# EasyEDA Pro project BCI_TESTING_BOARD.eprj, schematic BCI_ADS1299

## Sheets
1 ESP and Power: Board Name: CK-C3-Mini-085-4LY; Create Date: 2025-02-17; Page Name: ESP and Power; Project Name: BCI_TESTING_BOARD; Schematic Name: BCI_ADS1299; Update Date: 2025-05-24; Company: Designed by --nikki--; Page Size: A4; Version: V3.0
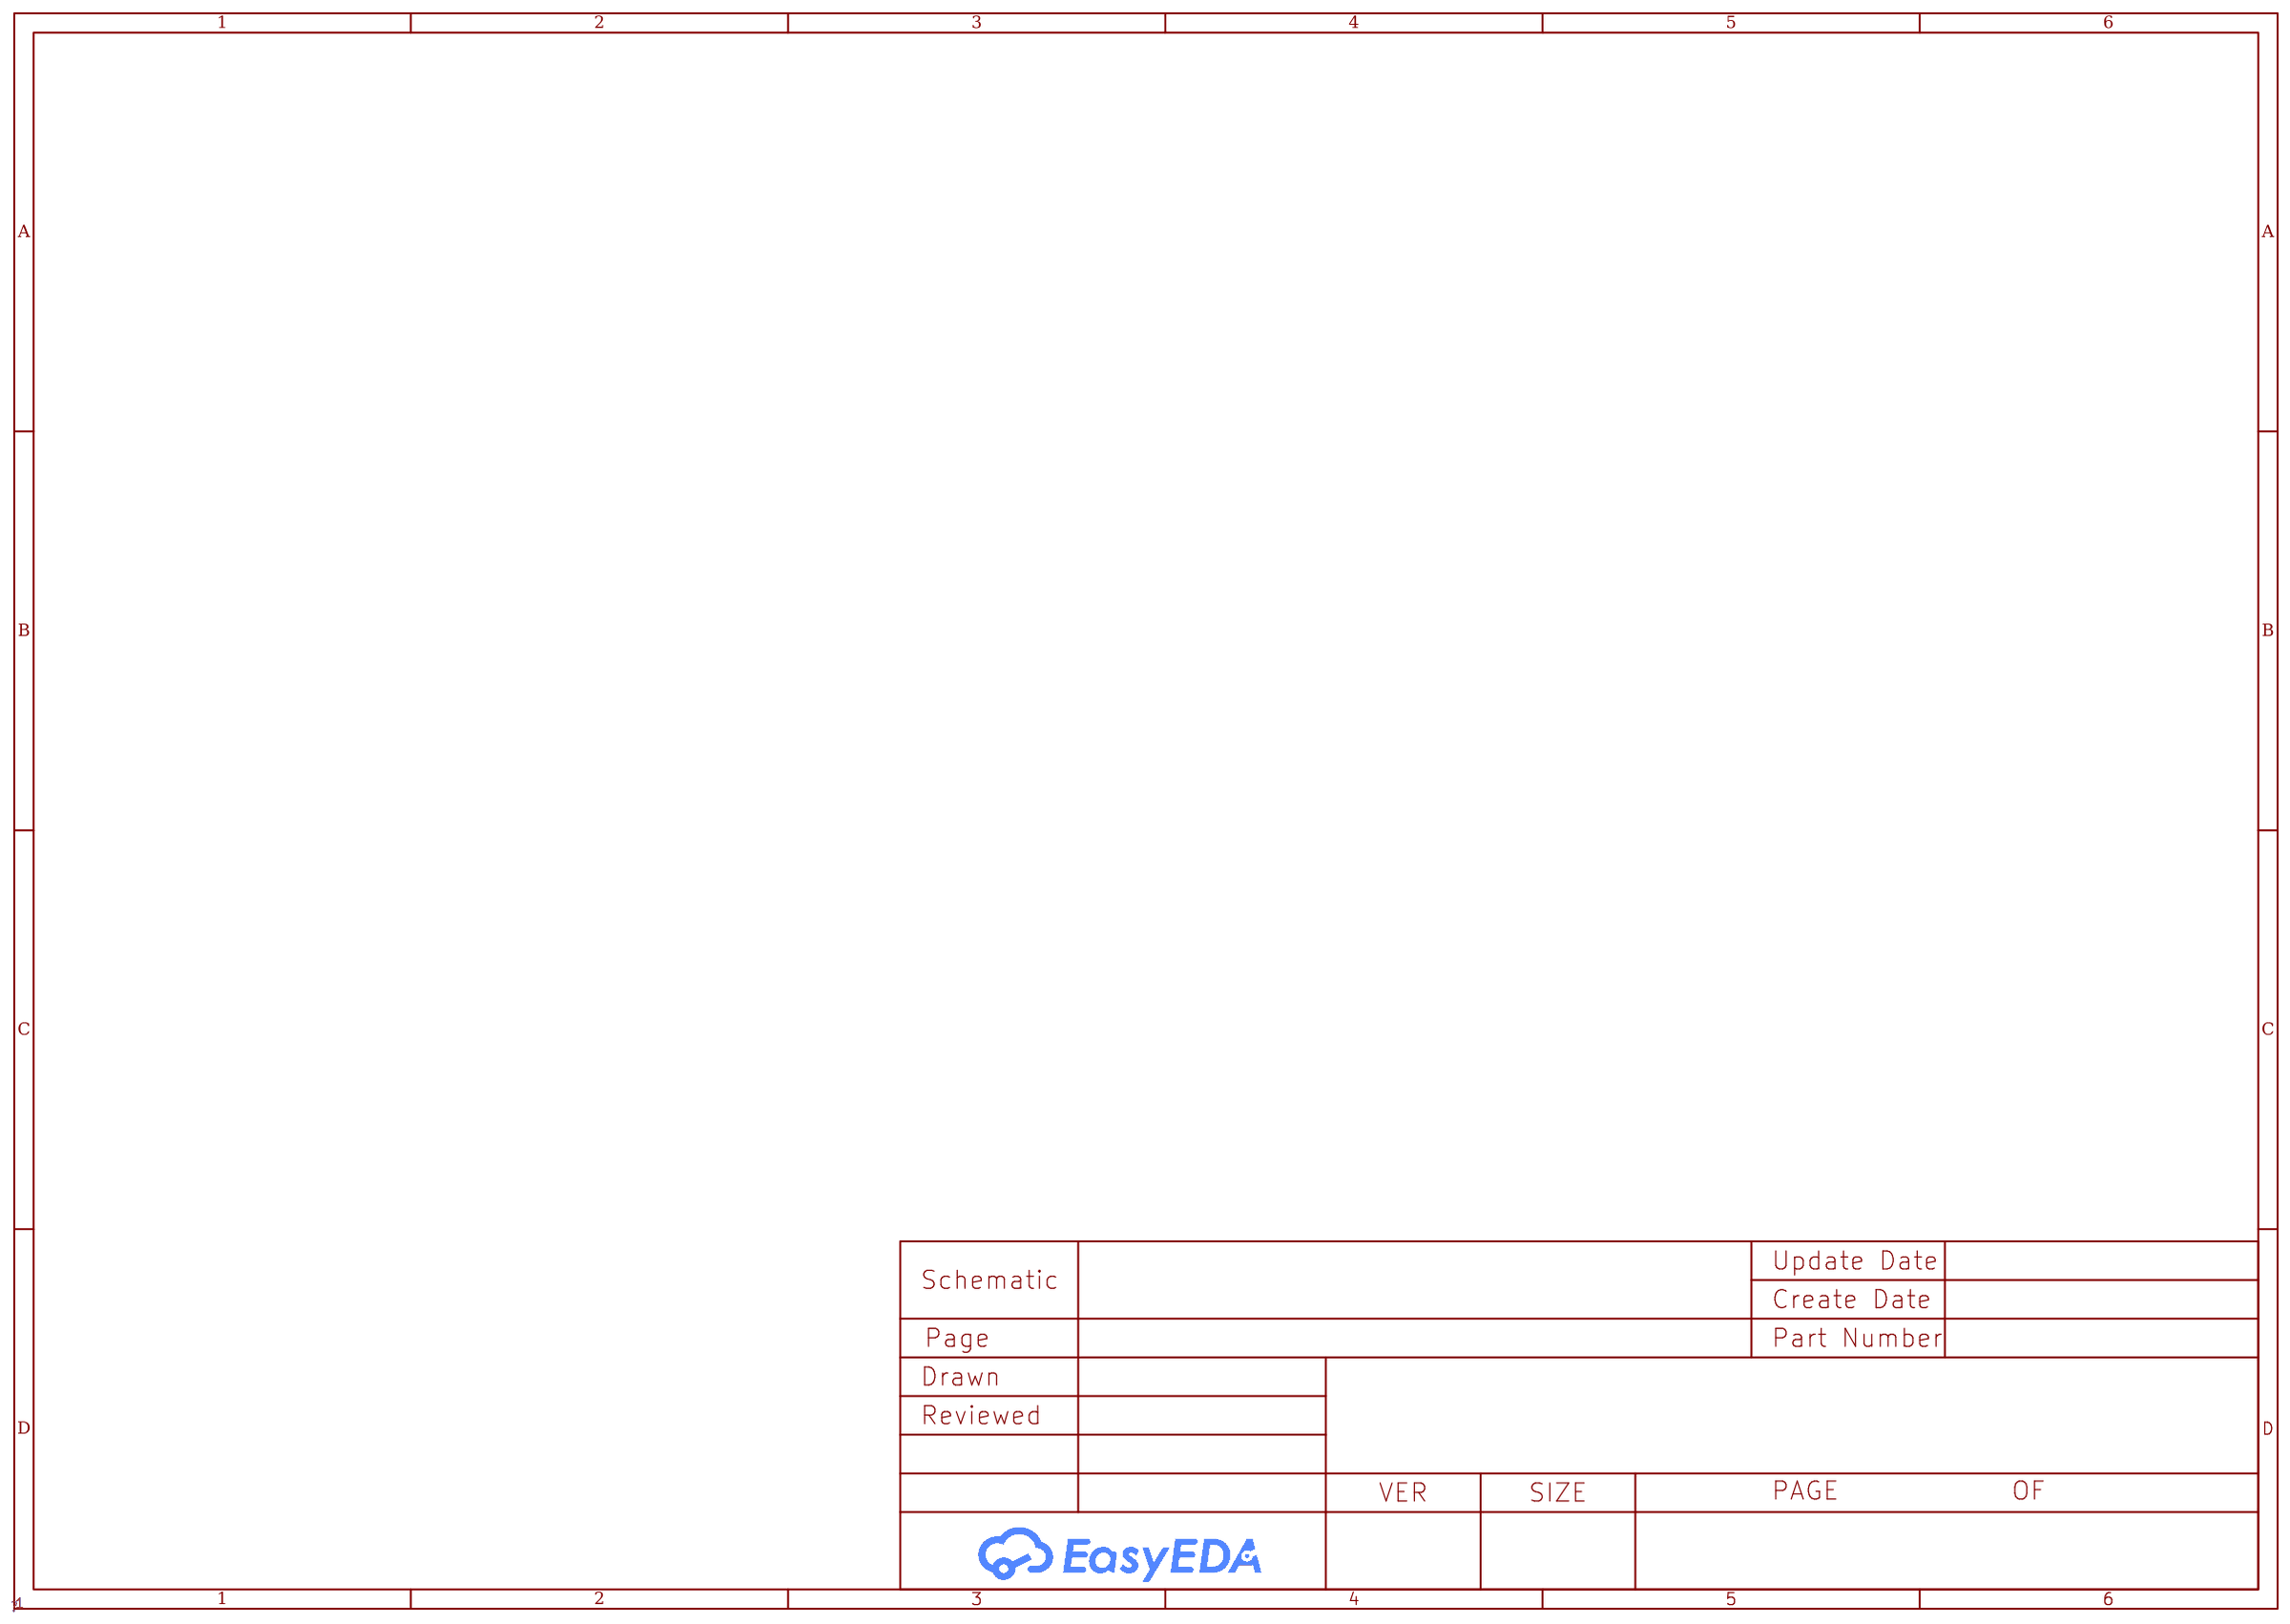
[diagram p0: ESP and Power]
2 ADCs: Create Date: 2025-05-08; Page Name: ADCs; Update Date: 2025-05-08
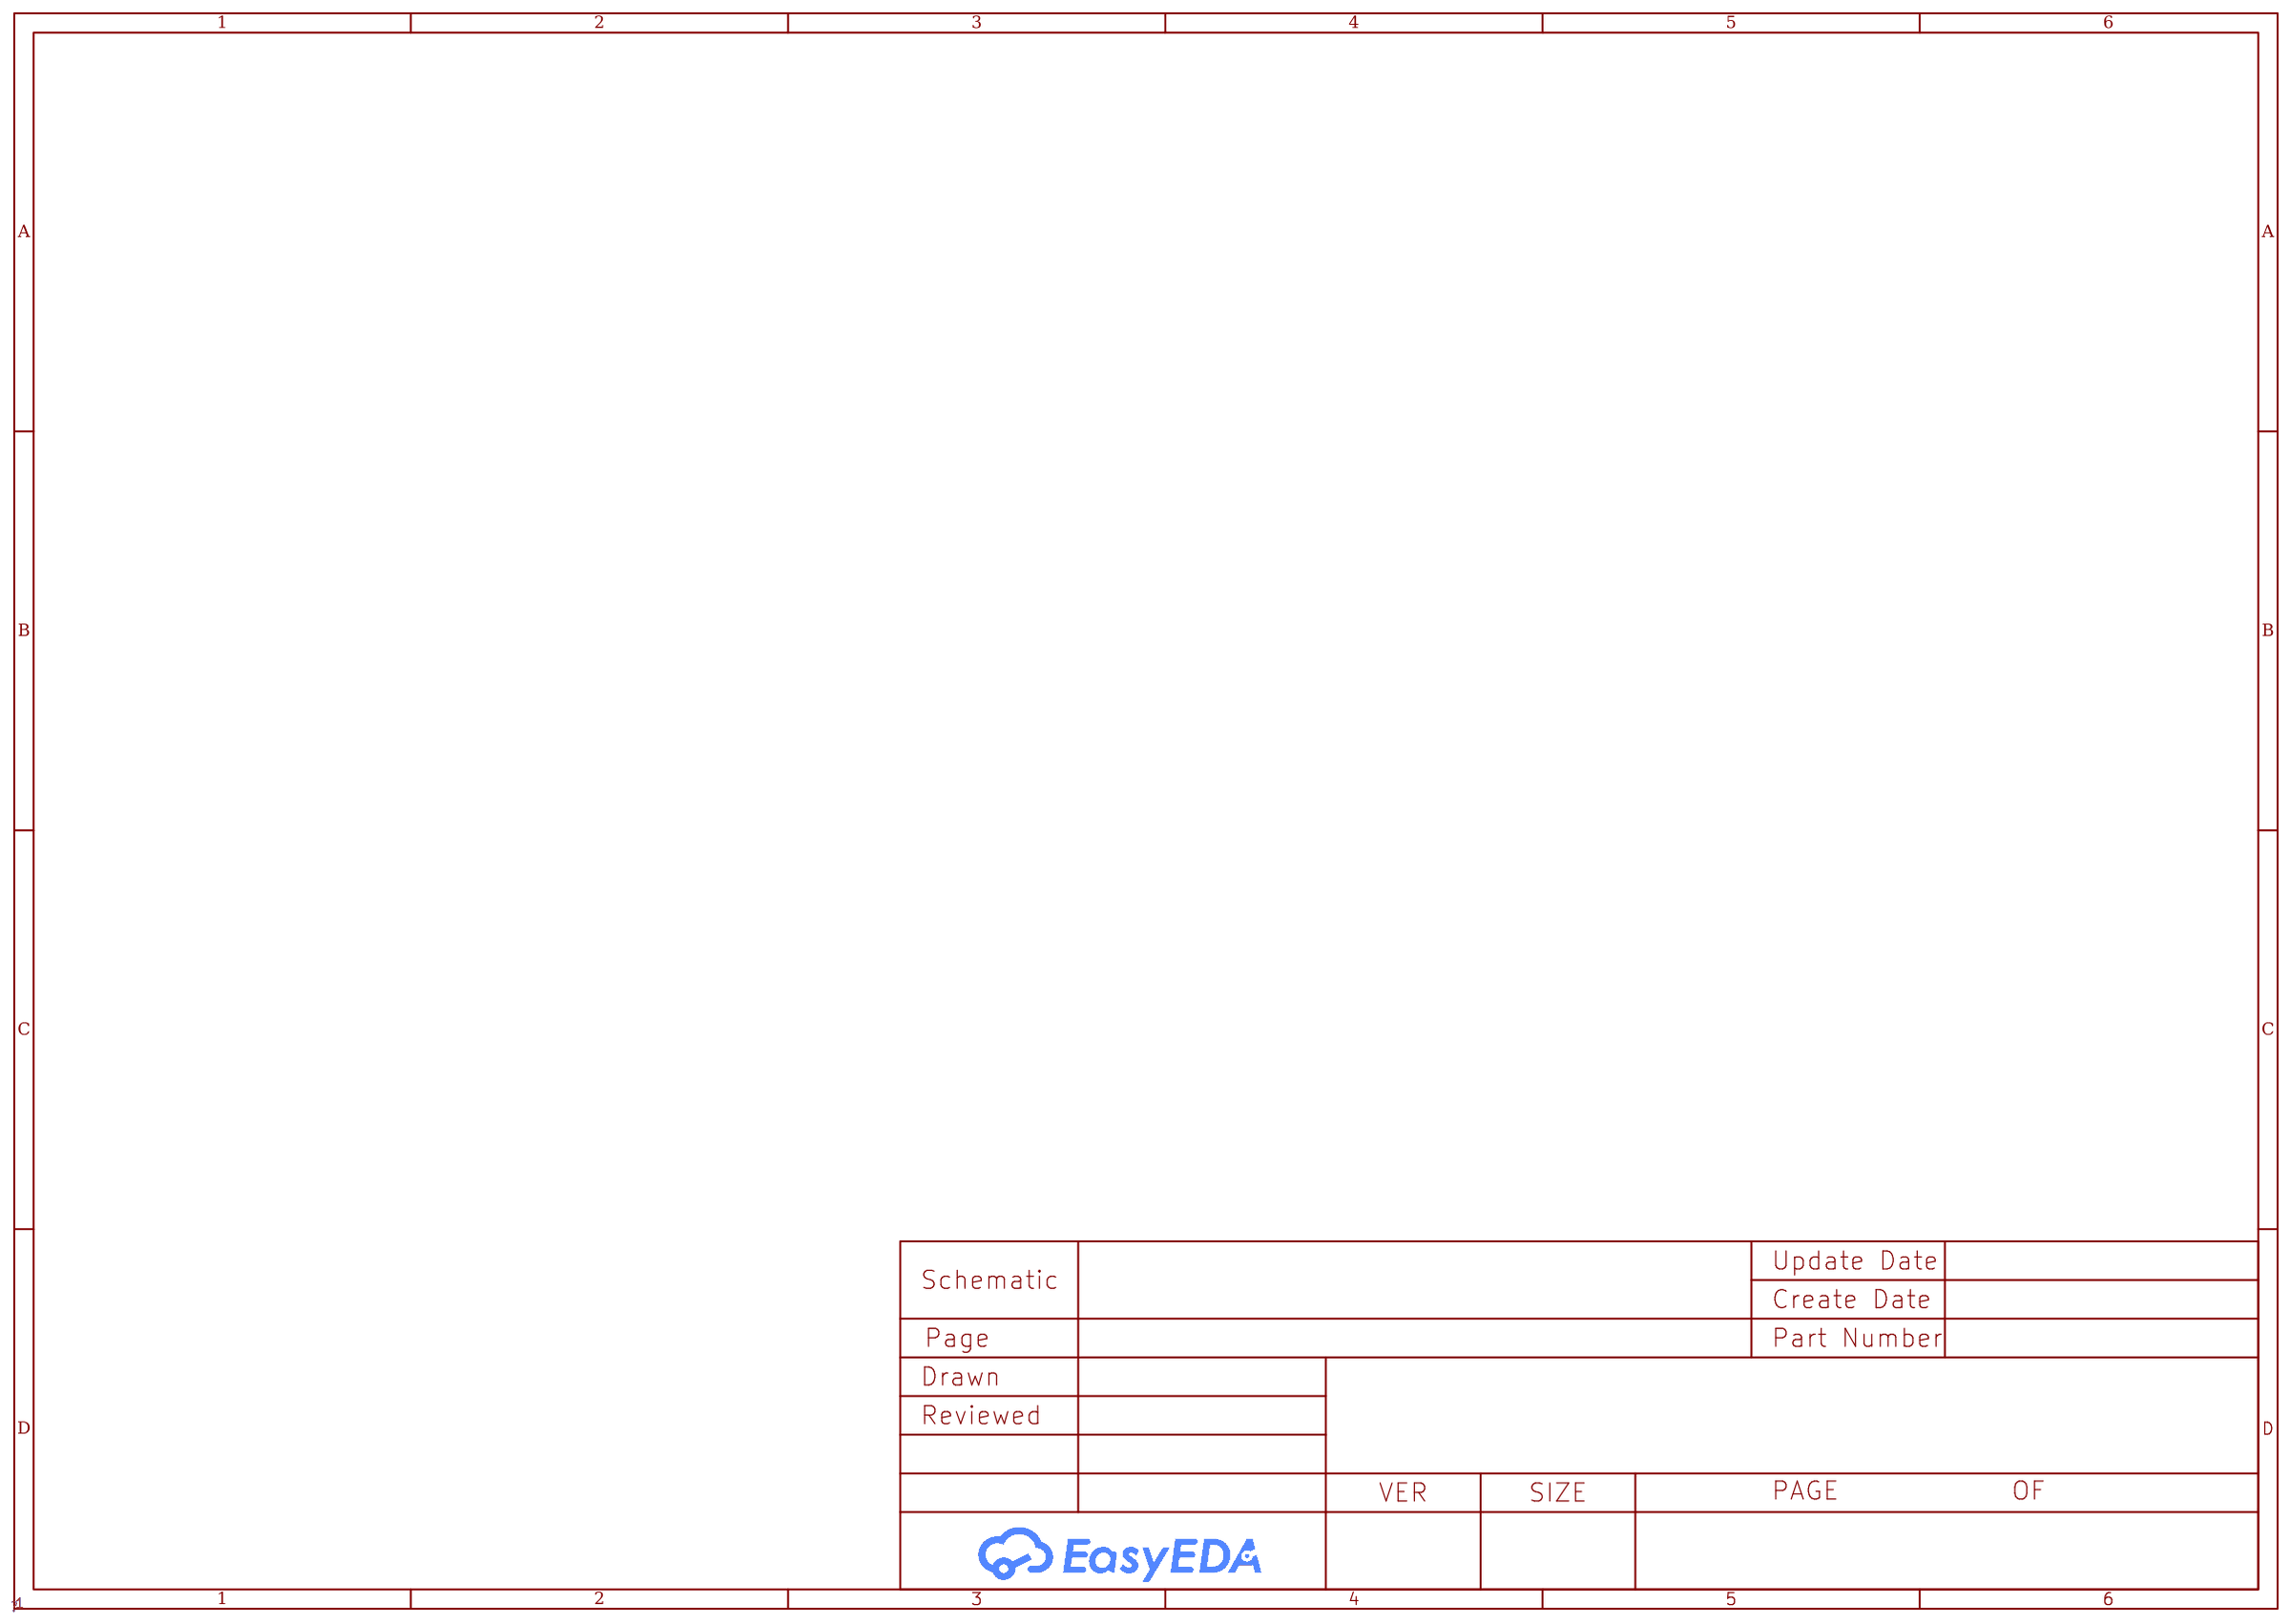
[diagram p1: ADCs]
3 ADC pins and connector: Create Date: 2025-05-08; Page Name: ADC pins and connector; Update Date: 2025-05-08
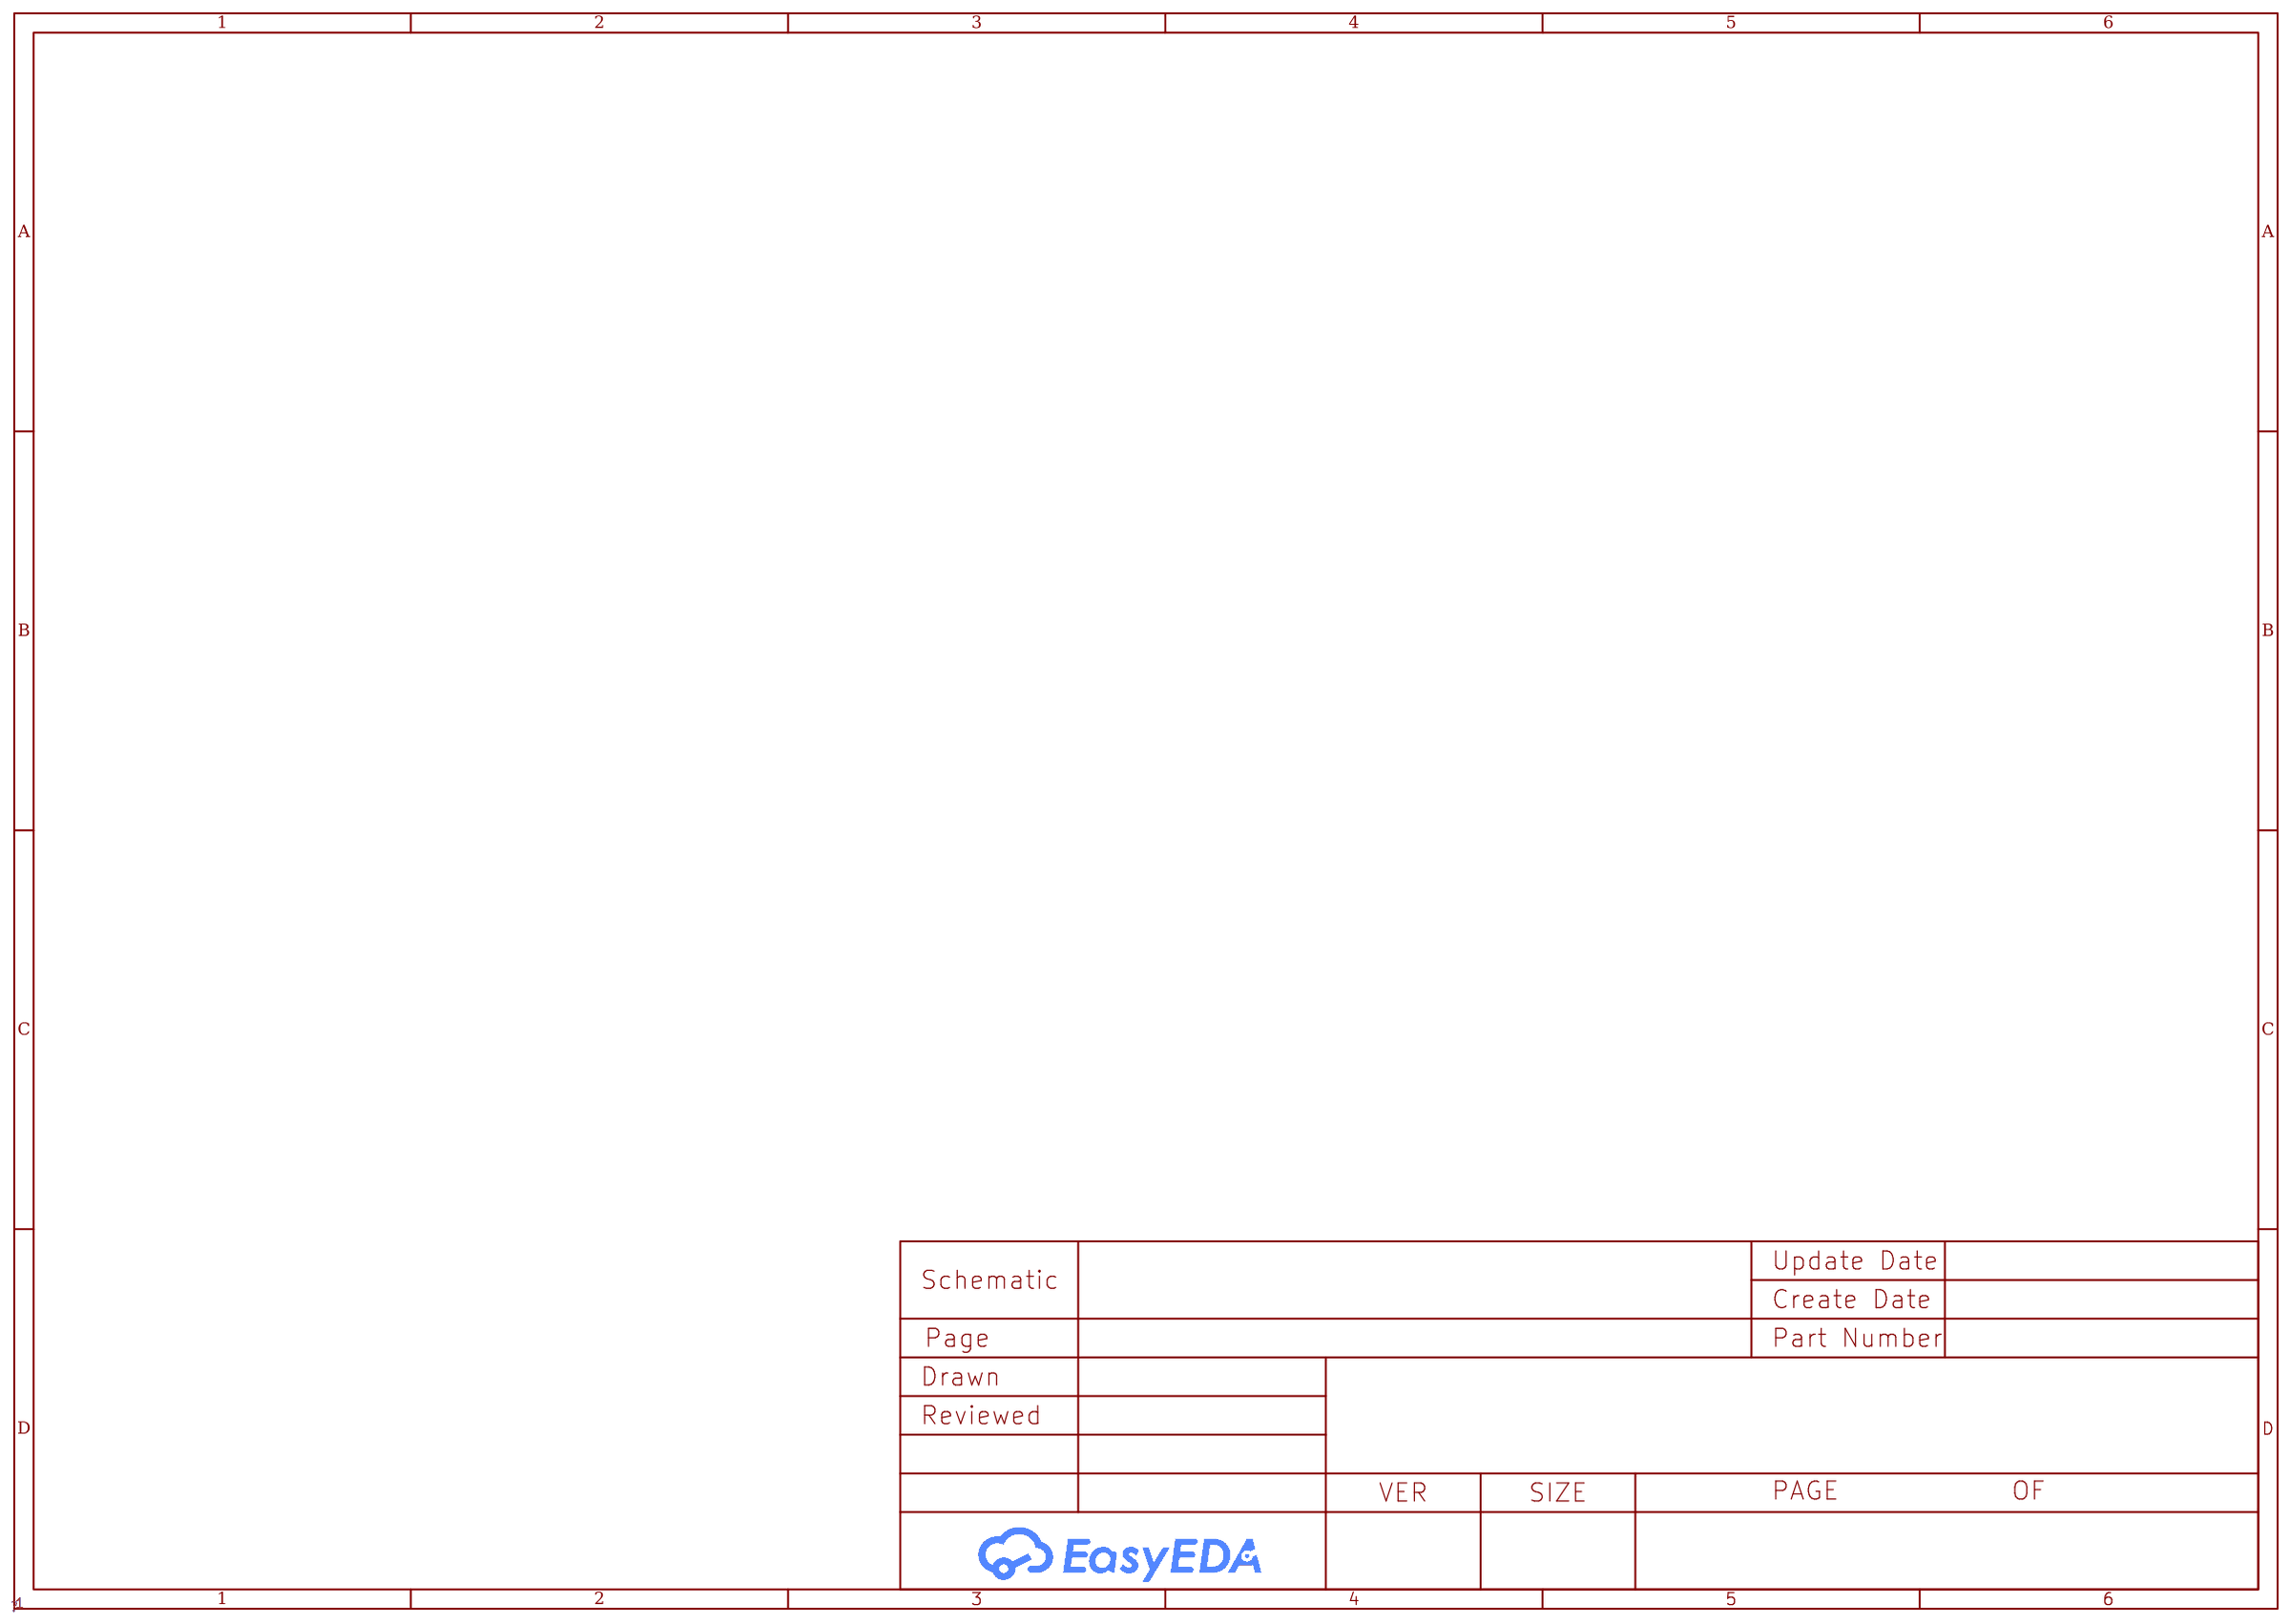
[diagram p2: ADC pins and connector]
4 Testing board: Create Date: 2025-05-24; Page Name: Testing board; Company: EasyEDA.com; Version: V1.0
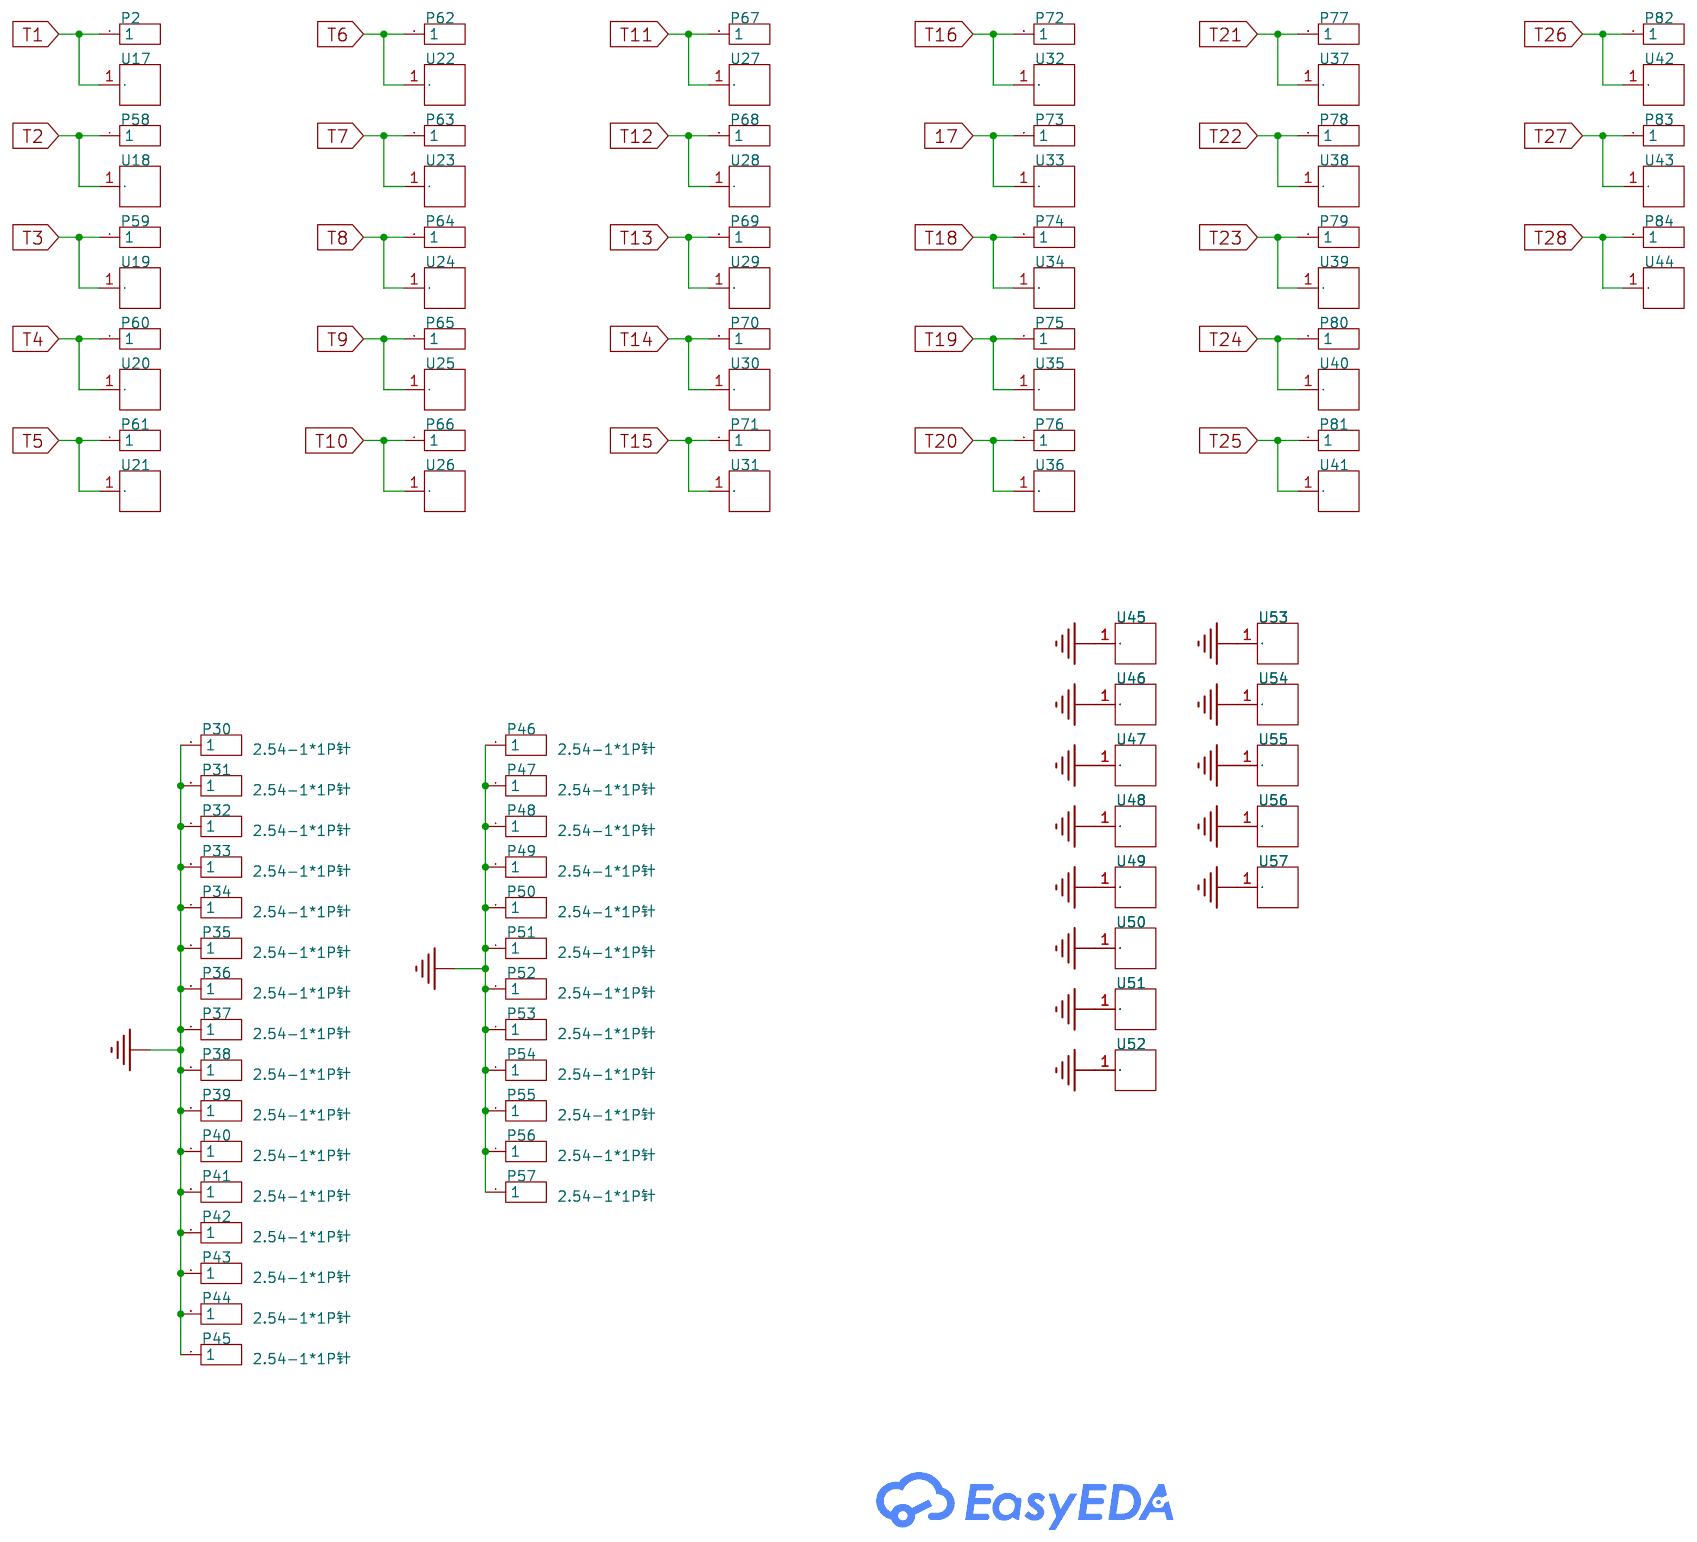
[diagram p3: Testing board]

## Parts
P2  2.54-1*1P针  [HDR-TH_1P-P2.54-V-M]
P30  2.54-1*1P针  [HDR-TH_1P-P2.54-V-M]
P31  2.54-1*1P针  [HDR-TH_1P-P2.54-V-M]
P32  2.54-1*1P针  [HDR-TH_1P-P2.54-V-M]
P33  2.54-1*1P针  [HDR-TH_1P-P2.54-V-M]
P34  2.54-1*1P针  [HDR-TH_1P-P2.54-V-M]
P35  2.54-1*1P针  [HDR-TH_1P-P2.54-V-M]
P36  2.54-1*1P针  [HDR-TH_1P-P2.54-V-M]
P37  2.54-1*1P针  [HDR-TH_1P-P2.54-V-M]
P38  2.54-1*1P针  [HDR-TH_1P-P2.54-V-M]
P39  2.54-1*1P针  [HDR-TH_1P-P2.54-V-M]
P40  2.54-1*1P针  [HDR-TH_1P-P2.54-V-M]
P41  2.54-1*1P针  [HDR-TH_1P-P2.54-V-M]
P42  2.54-1*1P针  [HDR-TH_1P-P2.54-V-M]
P43  2.54-1*1P针  [HDR-TH_1P-P2.54-V-M]
P44  2.54-1*1P针  [HDR-TH_1P-P2.54-V-M]
P45  2.54-1*1P针  [HDR-TH_1P-P2.54-V-M]
P46  2.54-1*1P针  [HDR-TH_1P-P2.54-V-M]
P47  2.54-1*1P针  [HDR-TH_1P-P2.54-V-M]
P48  2.54-1*1P针  [HDR-TH_1P-P2.54-V-M]
P49  2.54-1*1P针  [HDR-TH_1P-P2.54-V-M]
P50  2.54-1*1P针  [HDR-TH_1P-P2.54-V-M]
P51  2.54-1*1P针  [HDR-TH_1P-P2.54-V-M]
P52  2.54-1*1P针  [HDR-TH_1P-P2.54-V-M]
P53  2.54-1*1P针  [HDR-TH_1P-P2.54-V-M]
P54  2.54-1*1P针  [HDR-TH_1P-P2.54-V-M]
P55  2.54-1*1P针  [HDR-TH_1P-P2.54-V-M]
P56  2.54-1*1P针  [HDR-TH_1P-P2.54-V-M]
P57  2.54-1*1P针  [HDR-TH_1P-P2.54-V-M]
P58  2.54-1*1P针  [HDR-TH_1P-P2.54-V-M]
P59  2.54-1*1P针  [HDR-TH_1P-P2.54-V-M]
P60  2.54-1*1P针  [HDR-TH_1P-P2.54-V-M]
P61  2.54-1*1P针  [HDR-TH_1P-P2.54-V-M]
P62  2.54-1*1P针  [HDR-TH_1P-P2.54-V-M]
P63  2.54-1*1P针  [HDR-TH_1P-P2.54-V-M]
P64  2.54-1*1P针  [HDR-TH_1P-P2.54-V-M]
P65  2.54-1*1P针  [HDR-TH_1P-P2.54-V-M]
P66  2.54-1*1P针  [HDR-TH_1P-P2.54-V-M]
P67  2.54-1*1P针  [HDR-TH_1P-P2.54-V-M]
P68  2.54-1*1P针  [HDR-TH_1P-P2.54-V-M]
P69  2.54-1*1P针  [HDR-TH_1P-P2.54-V-M]
P70  2.54-1*1P针  [HDR-TH_1P-P2.54-V-M]
P71  2.54-1*1P针  [HDR-TH_1P-P2.54-V-M]
P72  2.54-1*1P针  [HDR-TH_1P-P2.54-V-M]
P73  2.54-1*1P针  [HDR-TH_1P-P2.54-V-M]
P74  2.54-1*1P针  [HDR-TH_1P-P2.54-V-M]
P75  2.54-1*1P针  [HDR-TH_1P-P2.54-V-M]
P76  2.54-1*1P针  [HDR-TH_1P-P2.54-V-M]
P77  2.54-1*1P针  [HDR-TH_1P-P2.54-V-M]
P78  2.54-1*1P针  [HDR-TH_1P-P2.54-V-M]
P79  2.54-1*1P针  [HDR-TH_1P-P2.54-V-M]
P80  2.54-1*1P针  [HDR-TH_1P-P2.54-V-M]
P81  2.54-1*1P针  [HDR-TH_1P-P2.54-V-M]
P82  2.54-1*1P针  [HDR-TH_1P-P2.54-V-M]
P83  2.54-1*1P针  [HDR-TH_1P-P2.54-V-M]
P84  2.54-1*1P针  [HDR-TH_1P-P2.54-V-M]
U17  BWCD-L5.0W2.0H2.5  [CONN-SMD_BWCD-L5.0W2.0H2.5]
U18  BWCD-L5.0W2.0H2.5  [CONN-SMD_BWCD-L5.0W2.0H2.5]
U19  BWCD-L5.0W2.0H2.5  [CONN-SMD_BWCD-L5.0W2.0H2.5]
U20  BWCD-L5.0W2.0H2.5  [CONN-SMD_BWCD-L5.0W2.0H2.5]
U21  BWCD-L5.0W2.0H2.5  [CONN-SMD_BWCD-L5.0W2.0H2.5]
U22  BWCD-L5.0W2.0H2.5  [CONN-SMD_BWCD-L5.0W2.0H2.5]
U23  BWCD-L5.0W2.0H2.5  [CONN-SMD_BWCD-L5.0W2.0H2.5]
U24  BWCD-L5.0W2.0H2.5  [CONN-SMD_BWCD-L5.0W2.0H2.5]
U25  BWCD-L5.0W2.0H2.5  [CONN-SMD_BWCD-L5.0W2.0H2.5]
U26  BWCD-L5.0W2.0H2.5  [CONN-SMD_BWCD-L5.0W2.0H2.5]
U27  BWCD-L5.0W2.0H2.5  [CONN-SMD_BWCD-L5.0W2.0H2.5]
U28  BWCD-L5.0W2.0H2.5  [CONN-SMD_BWCD-L5.0W2.0H2.5]
U29  BWCD-L5.0W2.0H2.5  [CONN-SMD_BWCD-L5.0W2.0H2.5]
U30  BWCD-L5.0W2.0H2.5  [CONN-SMD_BWCD-L5.0W2.0H2.5]
U31  BWCD-L5.0W2.0H2.5  [CONN-SMD_BWCD-L5.0W2.0H2.5]
U32  BWCD-L5.0W2.0H2.5  [CONN-SMD_BWCD-L5.0W2.0H2.5]
U33  BWCD-L5.0W2.0H2.5  [CONN-SMD_BWCD-L5.0W2.0H2.5]
U34  BWCD-L5.0W2.0H2.5  [CONN-SMD_BWCD-L5.0W2.0H2.5]
U35  BWCD-L5.0W2.0H2.5  [CONN-SMD_BWCD-L5.0W2.0H2.5]
U36  BWCD-L5.0W2.0H2.5  [CONN-SMD_BWCD-L5.0W2.0H2.5]
U37  BWCD-L5.0W2.0H2.5  [CONN-SMD_BWCD-L5.0W2.0H2.5]
U38  BWCD-L5.0W2.0H2.5  [CONN-SMD_BWCD-L5.0W2.0H2.5]
U39  BWCD-L5.0W2.0H2.5  [CONN-SMD_BWCD-L5.0W2.0H2.5]
U40  BWCD-L5.0W2.0H2.5  [CONN-SMD_BWCD-L5.0W2.0H2.5]
U41  BWCD-L5.0W2.0H2.5  [CONN-SMD_BWCD-L5.0W2.0H2.5]
U42  BWCD-L5.0W2.0H2.5  [CONN-SMD_BWCD-L5.0W2.0H2.5]
U43  BWCD-L5.0W2.0H2.5  [CONN-SMD_BWCD-L5.0W2.0H2.5]
U44  BWCD-L5.0W2.0H2.5  [CONN-SMD_BWCD-L5.0W2.0H2.5]
U45  BWCD-L5.0W2.0H2.5  [CONN-SMD_BWCD-L5.0W2.0H2.5]
U46  BWCD-L5.0W2.0H2.5  [CONN-SMD_BWCD-L5.0W2.0H2.5]
U47  BWCD-L5.0W2.0H2.5  [CONN-SMD_BWCD-L5.0W2.0H2.5]
U48  BWCD-L5.0W2.0H2.5  [CONN-SMD_BWCD-L5.0W2.0H2.5]
U49  BWCD-L5.0W2.0H2.5  [CONN-SMD_BWCD-L5.0W2.0H2.5]
U50  BWCD-L5.0W2.0H2.5  [CONN-SMD_BWCD-L5.0W2.0H2.5]
U51  BWCD-L5.0W2.0H2.5  [CONN-SMD_BWCD-L5.0W2.0H2.5]
U52  BWCD-L5.0W2.0H2.5  [CONN-SMD_BWCD-L5.0W2.0H2.5]
U53  BWCD-L5.0W2.0H2.5  [CONN-SMD_BWCD-L5.0W2.0H2.5]
U54  BWCD-L5.0W2.0H2.5  [CONN-SMD_BWCD-L5.0W2.0H2.5]
U55  BWCD-L5.0W2.0H2.5  [CONN-SMD_BWCD-L5.0W2.0H2.5]
U56  BWCD-L5.0W2.0H2.5  [CONN-SMD_BWCD-L5.0W2.0H2.5]
U57  BWCD-L5.0W2.0H2.5  [CONN-SMD_BWCD-L5.0W2.0H2.5]

## Library data of the parts
P2 P30-P84 = 2.54-1*1P针: LCSC Part Name: 直插; Supplier Part: C81276; Manufacturer: BOOMELE(博穆精密); Supplier Footprint: 插件,P=2.54mm; JLCPCB Part Class: Extended Part; Datasheet: https://atta.szlcsc.com/upload/public/pdf/source/20221018/3E9408392E35E6F57A28985E5F7BF5C9.pdf; Supplier: LCSC; Mounting Type: Straight; Number of Rows: Single Row; Number of Pins: 1P; Color: Black
U17-U57 = BWCD-L5.0W2.0H2.5: LCSC Part Name: 天线顶针; Supplier Part: C2826549; Manufacturer: BAT WIRELESS(蝙蝠无线); JLCPCB Part Class: Extended Part; Datasheet: https://atta.szlcsc.com/upload/public/pdf/source/20210416/C2826549_AFE8D68941B02645C9C3BE17D86096B9.pdf; Supplier: LCSC

## Nets
GND: P30.1 P31.1 P32.1 P33.1 P34.1 P35.1 P36.1 P37.1 P38.1 P39.1 P40.1 P41.1 P42.1 P43.1 P44.1 P45.1 P46.1 P47.1 P48.1 P49.1 P50.1 P51.1 P52.1 P53.1 P54.1 P55.1 P56.1 P57.1 U45.1 U46.1 U47.1 U48.1 U49.1 U50.1 U51.1 U52.1 U53.1 U54.1 U55.1 U56.1 U57.1
17: P73.1 U33.1
T1: P2.1 U17.1
T2: P58.1 U18.1
T3: P59.1 U19.1
T4: P60.1 U20.1
T5: P61.1 U21.1
T6: P62.1 U22.1
T7: P63.1 U23.1
T8: P64.1 U24.1
T9: P65.1 U25.1
T10: P66.1 U26.1
T11: P67.1 U27.1
T12: P68.1 U28.1
T13: P69.1 U29.1
T14: P70.1 U30.1
T15: P71.1 U31.1
T16: P72.1 U32.1
T18: P74.1 U34.1
T19: P75.1 U35.1
T20: P76.1 U36.1
T21: P77.1 U37.1
T22: P78.1 U38.1
T23: P79.1 U39.1
T24: P80.1 U40.1
T25: P81.1 U41.1
T26: P82.1 U42.1
T27: P83.1 U43.1
T28: P84.1 U44.1
